# EasyEDA Pro project ProProject_IMUSensorNodes202312.epro, board 顺时针节点PCB
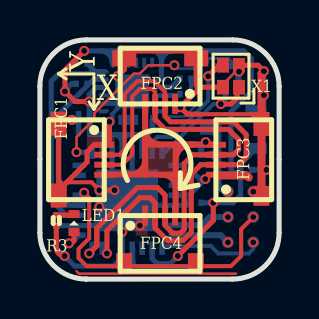
[diagram p8: board, top side]
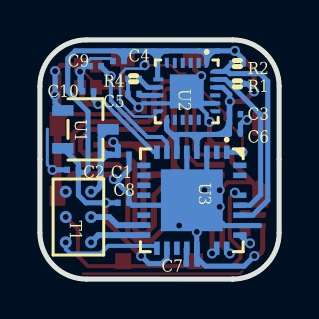
[diagram p9: board, bottom side, seen from below]

Outline 12 x 12 mm; copper layers: Top Layer, Bottom Layer. Coordinates in mm from the lower left corner of the outline.
Outline path: 0,9.67 arc(0.68,11.32) 2.33,12 9.67,12 arc(11.32,11.32) 12,9.67 12,2.33 arc(11.32,0.68) 9.67,0 2.32,0 2.33,0 arc(0.68,0.68) 0,2.33 0,9.67
Stack: Top Layer 0.035mm / Dielectric1 1.51mm FR4 er 4.5 / Bottom Layer 0.035mm

## Design rules (mm)
template: 自定义配置
spacing copperThickness1oz (default): track to track 0.102, other pairs 0.102 to 0.3
spacing copperThickness2oz: track to track 0.203, other pairs 0.152 to 0.3
track width copperThickness1oz (default): min 0.127, default 0.254, max 2.54
track width copperThickness2oz: min 0.203, default 0.254, max 2.54
differential pair differentialPair (default): width min 0.127, default 0.254, max 2.54; gap min 0.152, default 0.152
via viaSize (default): diameter min 0.5, default 0.61, max 10; hole min 0.3, default 0.305, max 6.299
net GND uses copperRegion1

## Placement (name value [footprint] x y rotation side)
C1  1uf  [C0201]  7.81 6.24 180 bottom
C2  1uf  [C0201]  10.35 5.48 0 bottom
C3  0.1uf  [C0201]  2.22 8.27 180 bottom
C4  0.1uf  [C0201]  8.06 10.94 0 bottom
C5  0.1uf  [C0201]  7.3 9.29 180 bottom
C6  0.1uf  [C0201]  2.22 7.38 0 bottom
C7  0.1uf  [C0201]  4.38 0.78 0 bottom
C8  0.1uf  [C0201]  7.81 3.83 180 bottom
C9  9pF  [C0201]  9.21 10.69 180 bottom
C10  9pF  [C0201]  9.59 9.42 0 bottom
FPC1  FPC 0.5MM间距 4P 前插后锁 H1mm 下接  [fpc-0.5mm-4p-h1.0]  3.23 5.99 270 top
FPC2  FPC 0.5MM间距 4P 前插后锁 H1mm 下接  [fpc-0.5mm-4p-h1.0]  6.03 8.79 180 top
FPC3  FPC 0.5MM间距 4P 前插后锁 H1mm 下接  [fpc-0.5mm-4p-h1.0#2]  8.83 5.99 90 top
FPC4  FPC 0.5MM间距 4P 前插后锁 H1mm 下接  [fpc-0.5mm-4p-h1.0#3]  6.03 3.19 0 top
LED1  白色LED  [LED0402]  1.71 2.81 90 top
R1  4K7  [R0201]  2.09 9.8 0 bottom
R2  4K7  [R0201]  2.09 10.81 0 bottom
R3  1K  [R0201]  0.82 2.94 270 top
R4  10K  [R0201]  7.3 10.05 180 bottom
T1  程序烧录焊点  [TEST]  9.43 4.38 270 bottom
U1  XC6206P332MR  [SOT-23-3_L2.9-W1.6-P1.90-LS2.8-BR]  9.71 7.51 0 bottom
U2  MPU-9250  [QFN-24_L3.0-W3.0-P0.40-BL-EP]  4.63 9.42 0 bottom
U3  ATMEGA328P-MU  [VQFN-32_L5.0-W5.0-P0.50-TL-EP3.1]  4.38 3.95 270 bottom
X1  16MHz  [CRYSTAL-SMD_4P-L1.6-W1.2-BL]  9.59 10.18 90 top

## Footprints (pads in the part's own frame, mm; a bottom-side part is the same pattern mirrored in y, then rotated)
C0201
  rect 0.28x0.318 smd: 1(-0.28,0) 2(0.28,0)
CRYSTAL-SMD_4P-L1.6-W1.2-BL
  rect 0.73x0.6 smd: 1(-0.55,-0.4) 2(0.55,-0.4) 3(0.55,0.4) 4(-0.55,0.4)
fpc-0.5mm-4p-h1.0
  rect 0.3x1 smd: 1(-0.75,0) 2(-0.251,0) 3(0.249,0) 4(0.75,0)
  rect 1.2x0.8 smd: 5(-1.81,-2.286) 6(1.794,-2.286)
fpc-0.5mm-4p-h1.0#2
  rect 0.3x1 smd: 1(-0.75,0) 2(-0.251,0) 3(0.249,0) 4(0.75,0)
  rect 1x0.8 smd: 5(-1.81,-2.286)
  rect 1.2x0.8 smd: 6(1.794,-2.286)
fpc-0.5mm-4p-h1.0#3
  rect 0.3x1 smd: 1(-0.75,0) 2(-0.251,0) 3(0.249,0) 4(0.75,0)
  rect 0.8x0.8 smd: 5(-1.81,-2.286) 6(1.794,-2.286)
LED0402
  rect 0.4x0.55 smd: 1(-0.45,0) 2(0.45,0)
QFN-24_L3.0-W3.0-P0.40-BL-EP
  custom 0.2x0.506 smd: 1(-1,-1.427) 6(1,-1.427) 13(1,1.427) 18(-1,1.427)
  rect 0.2x0.505 smd: 2(-0.6,-1.427) 3(-0.2,-1.427) 4(0.2,-1.427) 5(0.6,-1.427) 14(0.6,1.427) 15(0.2,1.427) 16(-0.2,1.427) 17(-0.6,1.427)
  rect 0.003x0.003 smd: 7(1.425,-0.997)
  rect 0.505x0.2 smd: 8(1.427,-0.6) 9(1.427,-0.2) 10(1.427,0.2) 11(1.427,0.6) 20(-1.427,0.6) 21(-1.427,0.2) 22(-1.427,-0.2) 23(-1.427,-0.6)
  custom 0.506x0.2 smd: 12(1.427,1) 19(-1.427,1) 24(-1.427,-1)
  rect 1.7x1.7 smd: 25(0,0)
R0201
  rect 0.28x0.318 smd: 1(-0.28,0) 2(0.28,0)
SOT-23-3_L2.9-W1.6-P1.90-LS2.8-BR
  rect 1.07x0.532 smd: 1(1.135,-0.95) 2(1.135,0.95) 3(-1.135,0)
TEST
  round 0.6 smd: 1(0,0) 2(1.27,0) 3(2.54,0) 4(0,-1.27) 5(1.27,-1.27) 6(2.54,-1.27)
VQFN-32_L5.0-W5.0-P0.50-TL-EP3.1
  rect 0.665x0.28 smd: 1(-2.408,1.75) 2(-2.408,1.25) 3(-2.408,0.75) 4(-2.408,0.25) 5(-2.408,-0.25) 6(-2.408,-0.75) 7(-2.408,-1.25) 8(-2.408,-1.75) 17(2.408,-1.75) 18(2.408,-1.25) 19(2.408,-0.75) 20(2.408,-0.25) 21(2.408,0.25) 23(2.408,1.25) 24(2.408,1.75)
  rect 0.28x0.665 smd: 9(-1.75,-2.408) 10(-1.25,-2.408) 11(-0.75,-2.408) 12(-0.25,-2.408) 14(0.75,-2.408) 15(1.25,-2.408) 16(1.75,-2.408) 25(1.75,2.408) 27(0.75,2.408) 28(0.25,2.408) 29(-0.25,2.408) 31(-1.25,2.408) 32(-1.75,2.408)
  rect 3.1x3.1 smd: 33(0,0)

## Nets
As in the schematic, except:
GND: C1.2 C2.2 C3.2 C4.2 C5.1 C6.1 C7.1 C8.2 C9.1 C10.2 FPC1.1 FPC1.5 FPC1.6 FPC2.1 FPC2.5 FPC2.6 FPC3.1 FPC3.5 FPC3.6 FPC4.1 R3.2 R4.1 T1.4 U1.1 U2.11 U2.18 U2.20 U2.25 U3.3 U3.5 U3.21 U3.33 X1.2 X1.4
RESET: FPC4.5 FPC4.6 T1.5 U3.29

Pads without a net: U2 2 3 4 5 6 7 14 15 16 17 19 21; U3 2 9 10 11 12 14 19 31 32

## Via types
v1: diameter 0.5, hole 0.3, Top Layer to Bottom Layer, 35 vias

## Routing (per net, layer and track width the routed paths; a pad name or vN(x,y) marks a point on that pad's centre or on a via; arc(x,y) is an arc through that point)
3V3: length 51.8
  Top Layer w0.254: v1(2.22,11.45) 1.26,10.48 v1(1.26,9.42) 1.76,8.91 v1(2.47,8.91) ; v1(8.7,3.83) 8.7,2.94 v1(6.92,1.16)
  Bottom Layer w0.254: 2.47,8.9 2.47,7.79 2.5,7.76 ; 2.53,7.92 arc(2.72,7.45) 3.19,7.26 3.19,7.26 ; 3.37,7.26 3.67,7.26 arc(4,7.12) 4.13,6.8 arc(4.26,7.12) 4.59,7.26 4.77,7.26 ; 4.1,7.26 4.13,7.23 U3.4 ; U3.6 5.13,6.99 5.63,7.49 U2.13 5.63,7.87 arc(5.51,7.37) 5.01,7.26 ; 5.01,7.26 5.14,7.13 ; 5.01,7.26 2.5,7.26 C3.1 2.5,8.88 v1(2.47,8.91) 2.47,9.26 2.83,9.62 U2.22 ; 6.1,10.05 6.1,10.84 arc(6.27,11.27) 6.7,11.45 ; R2.1 1.81,11.04 v1(2.22,11.45) 3.03,11.45 ; C4.1 7.78,11.41 7.74,11.45 ; C4.1 arc(7.63,11.3) 7.28,11.45 ; C4.1 arc(7.93,11.3) 8.29,11.45 ; v1(6.92,1.16) 6.54,0.78 5.88,0.78 5.63,1.03 U3.18 ; v1(1.26,9.42) 1.26,9.47 1.59,9.8 R1.1 ; 7.74,11.45 7.28,11.45 ; 7.74,11.45 8.29,11.45 ; U1.2 10.07,5.78 C2.1 ; 3.63,11.05 3.63,11.45 ; 3.63,11.05 U2.1 arc(3.46,11.27) 3.03,11.45 ; 3.63,11.05 arc(3.75,11.33) 4.03,11.45 ; C2.1 10.07,4.21 9.69,3.83 v1(8.7,3.83) C8.1 ; C2.1 9.94,5.35 9.71,5.35 9.59,5.48 9.59,8.4 10.6,9.42 10.6,11.07 10.22,11.45 8.29,11.45 ; 7.28,11.45 6.7,11.45 ; 6.7,11.45 6.33,11.45 ; 6.35,11.42 6.33,11.45 ; 6.33,11.45 5.6,11.45 ; 6.1,11.42 6.1,10.95 arc(5.95,11.3) 5.6,11.45 ; 5.6,11.45 4.03,11.45 ; 3.03,11.45 4.03,11.45
5V: length 27.3
  Top Layer w0.3: 3.23,5.25 5.28,5.25 ; 5.28,5.25 5.28,6.75 6.81,6.75 ; 5.28,5.25 FPC2.4 ; 5.28,5.25 6.79,5.25 6.79,5.22 6.81,5.22 ; 4.47,5.25 4.56,5.25 arc(5.07,5.46) 5.28,5.97 ; 5.28,7.59 5.28,7.51 arc(5.5,6.97) 6.04,6.75 ; 6.04,5.22 6.2,5.22 arc(6.63,5.05) 6.81,4.62 ; 6.81,5.22 6.81,6.75 ; 6.81,5.22 6.81,3.19 ; 6.81,6.75 8.83,6.75 ; 6.81,5.99 arc(7.03,6.53) 7.57,6.75 7.82,6.75
  Bottom Layer w0.3: 8.95,6.75 8.95,7.14 U1.3 ; 8.95,6.75 arc(8.8,6.39) 8.44,6.24 ; 8.95,6.75 8.95,5.73 ; 8.44,6.24 C1.1 8.09,6.65 v1(8.32,6.88) ; 8.44,6.24 8.7,6.24 ; 8.44,6.24 arc(8.8,6.09) 8.95,5.73 ; 8.95,5.73 8.95,4.86 arc(9.09,4.52) v1(9.43,4.38)
GND: length 86.9
  Top Layer w0.127: 1.84,0.4 1.97,0.27 9.84,0.27 ; X1.2 9.99,10.58 9.19,9.78 X1.4
  Top Layer w0.2: 0.94,5.79 0.94,4.98 1.08,4.84 ; 1.35,4.86 2.59,4.86 v1(2.98,4.46) ; 8.06,8.27 10.63,8.27 FPC3.6
  Top Layer w0.254: v1(2.98,4.46) v1(3.74,4.46) ; 3.49,7.76 3.49,6.99 3.23,6.73 ; X1.2 10.94,10.73 v1(11.24,10.43) ; 0.94,4.45 2.37,5.87 2.37,6.39 2.72,6.74 FPC1.1 ; 0.94,4.45 FPC1.6 ; 0.94,4.45 FPC1.5 1.13,7.99 v1(1.61,7.99) ; X1.4 7.93,9.63 ; 7.93,9.63 7.84,9.71 FPC2.5 7.47,11.45 4.61,11.45 FPC2.6 4.24,10.51 v1(3.91,10.18) ; 7.93,9.63 7.93,9.5 v1(7.05,8.62) 7.39,8.27 8.06,8.27 ; R3.2 0.82,1.58 arc(0.95,1.28) v1(1.24,1.16)
  Top Layer w0.4: 8.95,5.2 10.37,5.2 10.48,5.1 ; v1(11.24,10.43) 11.12,10.31 FPC3.6 FPC3.5
  Bottom Layer w0.127: 9.71,10.69 9.59,10.81 9.59,10.94 ; C10.2 9.86,9.42 9.86,10.69
  Bottom Layer w0.15: v1(11.36,5.48) 11.62,5.74 11.62,7.52 ; C4.2 8.47,11.07 9.46,11.07 9.99,10.54 v1(9.99,10.41)
  Bottom Layer w0.2: U3.33 4.13,3.7 v1(4.13,2.37) U3.21 ; R4.1 C5.1 7.58,9.15 v1(7.05,8.62) 6.85,8.81 5.23,8.81 U2.25 4.63,9.29 3.63,8.29 U2.18
  Bottom Layer w0.254: v1(1.24,1.16) 1.75,0.65 3.69,0.65 4.13,1.09 U3.21 ; 0.98,2.68 2.73,2.68 2.86,2.81 3.49,2.81 ; U3.21 4.13,2.63 ; U3.21 4.13,0.81 C7.1 ; 5.57,3.7 7.38,3.7 7.5,3.83 ; U1.1 11.24,8.85 v1(11.24,10.43) ; C10.2 9.99,9.54 v1(9.99,10.41) 9.71,10.69 C9.1 ; 1.94,7.26 1.94,7.76 1.72,7.99 v1(1.61,7.99) ; C1.2 7.53,5.5 8.01,5.02 v1(8.29,5.02) 7.53,4.25 C8.2 ; U3.5 4.63,4.2 U3.33 4.25,3.95 v1(3.74,4.46) 3.63,4.58 U3.3 ; v1(11.36,5.48) C2.2 ; 3.21,8.81 4.03,8.81 arc(4.11,8.82) 4.18,8.83 arc(4.46,8.99) 4.62,9.27 arc(4.63,9.34) U2.25
  vias: v1(2.98,3.62) v1(3.49,7.89) v1(5.01,2.68) v1(10.7,4.38) v1(11.24,9.22)
IMU_INT: length 13.2
  Top Layer w0.127: v1(1.84,6.37) 1.84,7.13 2.73,8.02 2.73,8.32 4.71,10.3 5.01,10.3 5.44,10.73 v1(6.75,10.73)
  Bottom Layer w0.127: v1(6.75,10.73) 6.92,10.56 7.68,10.56 7.98,10.26 7.98,8.86 7.27,8.15 6.32,8.15 U2.12
  Bottom Layer w0.254: v1(1.84,6.37) 2.6,6.37
LED1: length 1.2
  Top Layer w0.254: LED1.1 1.71,1.92 1.59,1.8
  Bottom Layer w0.254: U3.25 1.59,1.82 1.59,1.8
  vias: v1(1.46,1.8)
MISO: length 2.8
  Bottom Layer w0.3: U3.16 9.07,2.2 v1(9.43,1.84)
MOSI: length 2.8
  Bottom Layer w0.3: U3.15 8.11,2.7 8.52,3.11 v1(9.43,3.11)
RESET: length 14.3
  Top Layer w0.2: 4.38,0.65 9.59,0.65 10.09,1.16 10.09,2.51 v1(10.7,3.11) ; v1(2.22,4.34) 2.47,4.08 2.47,2.05 1.94,1.51 1.94,1.06 2.35,0.65 3.97,0.65 FPC4.5
SCK: length 5.2
  Bottom Layer w0.2: v1(10.7,1.84) 10.7,1.51 10.48,1.29 8.95,1.29 8.57,1.67 6.25,1.67 U3.17
SCL: length 8.4
  Bottom Layer w0.254: U3.28 1.45,3.7 0.93,4.23 0.93,8.25 2.37,9.69 R1.2 2.47,9.8 2.69,10.02 U2.23
SDA: length 11.1
  Bottom Layer w0.254: U3.27 1.32,3.2 0.57,3.95 0.57,9.92 0.95,10.3 2.47,10.3 2.59,10.42 2.77,10.42 ; 2.77,10.42 U2.24 ; 2.77,10.42 R2.2
SOFTSCL: length 27.1
  Top Layer w0.2: FPC1.2 3.23,6.24 4,6.24 4.25,6.49 4.25,9.29 4.89,9.92 5.74,9.92 6.28,9.39 FPC2.2
  Top Layer w0.254: v1(3.36,1.29) 3.36,2.43 5.01,4.08 5.53,4.08 5.78,3.83 5.78,3.2 5.8,3.19 ; FPC2.2 6.28,8.16 6.55,7.89 9.71,7.89 10.35,7.26 10.35,6.11 9.97,5.74 FPC3.2 8.07,5.74 7.6,5.27 7.6,2.35 7.19,1.95 7.07,1.95 7.05,1.92 6.42,1.92 5.78,2.56 FPC4.2
SOFTSDA: length 28
  Top Layer w0.2: FPC1.3 4.13,5.74 4.63,6.24 4.63,9.16 5.01,9.54 5.63,9.54 5.78,9.39 FPC2.3
  Top Layer w0.254: 2.86,1.67 2.86,2.56 4.89,4.59 5.9,4.59 6.28,4.21 6.28,3.2 ; 2.86,1.67 v1(2.47,1.29) ; 2.86,1.67 2.86,2.43 ; FPC2.3 5.78,8.01 6.28,7.51 9.46,7.51 9.97,7 9.97,6.49 9.71,6.24 FPC3.3 7.68,6.24 7.24,5.8 7.24,2.5 7.05,2.3 6.67,2.3 6.28,2.69 FPC4.3
XTAL1: length 7.2
  Top Layer w0.254: v1(8.44,10.18) 8.95,10.69 9.31,10.69
  Bottom Layer w0.2: U3.7 5.63,6.86 5.9,7.13 6.62,7.13 8.44,8.95 v1(8.44,10.18)
  Bottom Layer w0.254: 8.95,10.69 v1(8.44,10.18)
XTAL2: length 6.1
  Top Layer w0.254: 9.89,9.57 9.89,9.09 9.59,8.78 v1(9.08,8.78)
  Bottom Layer w0.2: v1(9.08,8.78) 8.7,8.78 6.28,6.36 U3.8
  Bottom Layer w0.254: C10.1 9.31,9.01 v1(9.08,8.78)
$1N1156: length 0.8
  Bottom Layer w0.254: U3.20 4.66,1.52 C7.2
$1N1216: length 1.1
  Bottom Layer w0.254: U2.9 6.59,9.62 R4.2
$1N1217: length 0.9
  Bottom Layer w0.254: U2.10 6.97,9.22
$1N1134: length 0.8
  Top Layer w0.254: R3.1 0.84,3.2 1.65,3.2

## Copper pours and planes (outline as drawn; the poured copper is in the pictures)
5V on Top Layer: 5.28,6.75 6.79,6.75 6.79,5.22 5.28,5.22
GND on Top Layer: -0.07,12.08 12,12.08 12,0.02 -0.07,0.02
GND on Bottom Layer: -0.07,12.08 12,12.08 12,0.02 -0.07,0.02

Small or netless copper shapes (teardrops, artwork), in the pictures only: 2 on Top Layer

## Text on the board
Top Silkscreen Layer: X | Y
